# EasyEDA Pro project wukong01-Y003-HTOL.eprj, board PCB1 (continued)
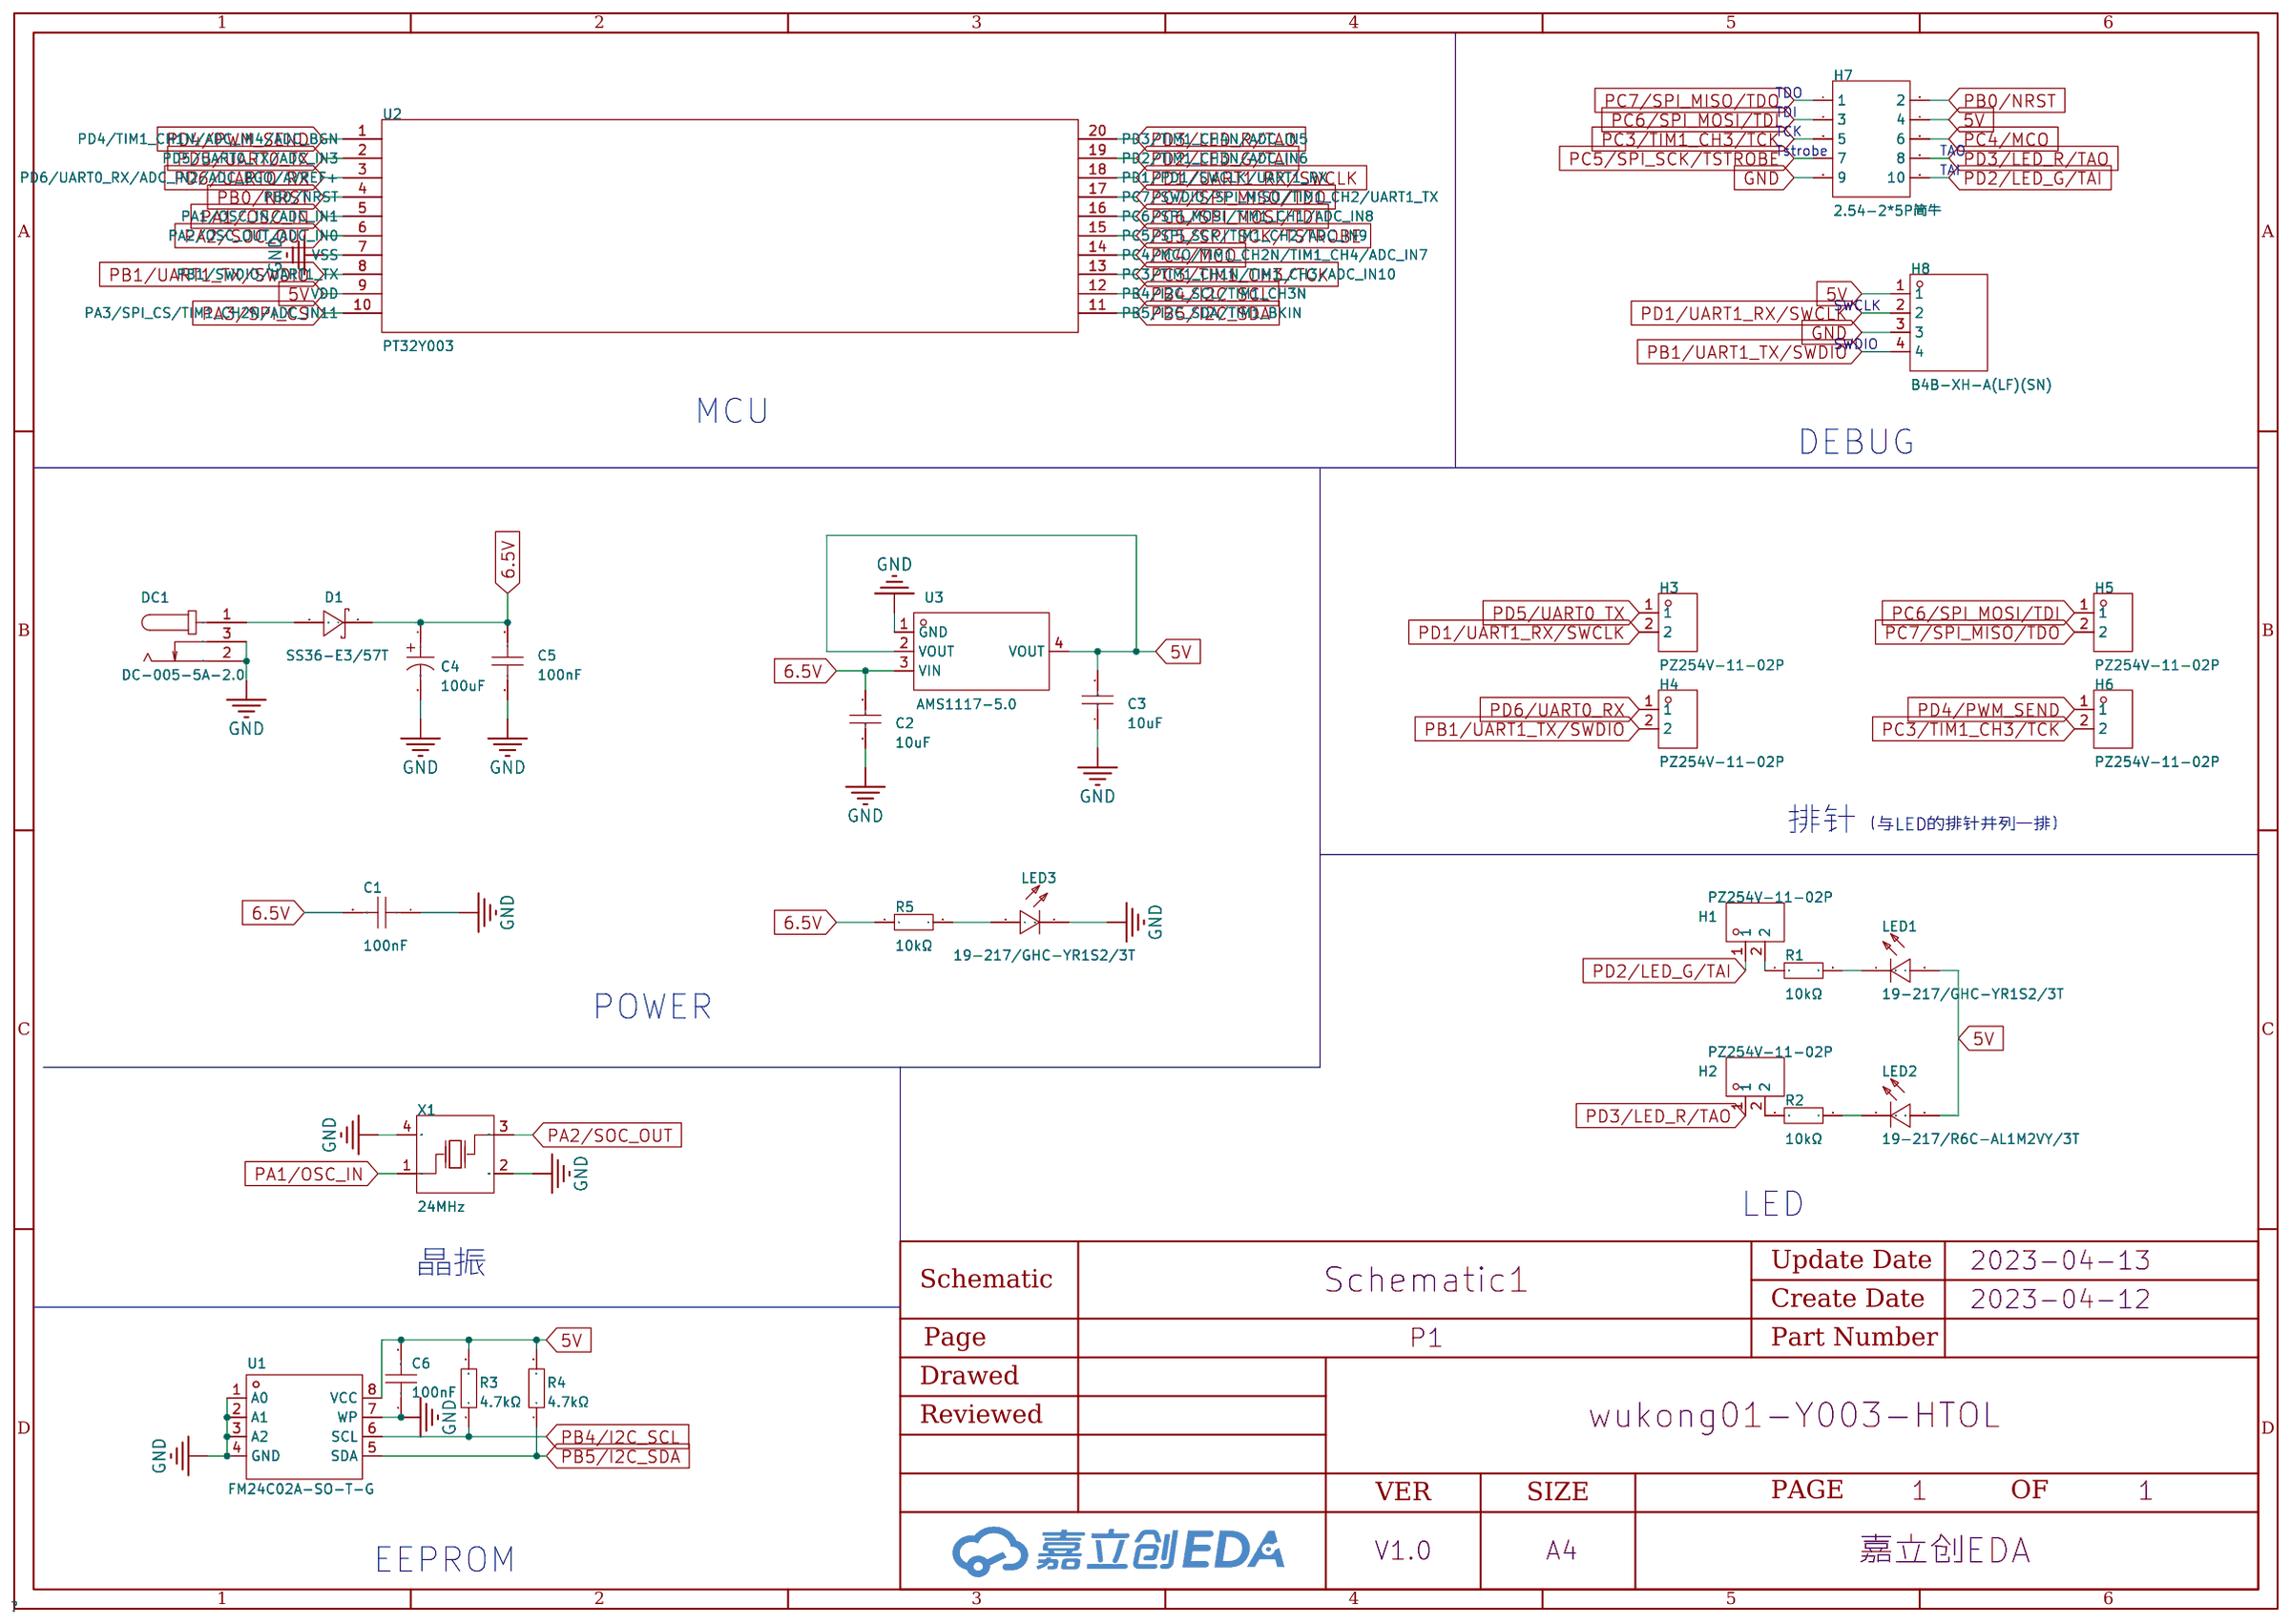
[diagram p0: schematic sheet]
## Routing (per net, layer and track width the routed paths; a pad name or vN(x,y) marks a point on that pad's centre or on a via; arc(x,y) is an arc through that point) (continued)
PA1/OSC_IN: length 642.8
  Top Layer w0.254: X1#7.1 63.82,283.43 72.34,274.9 U2#9.5 ; X1.1 210.88,111.72 219.41,103.2 U2#4.5 ; U2#37.5 268.43,146.12 259.9,154.65 X1#38.1 ; U2#32.5 219.41,189.05 210.88,197.57 X1#29.1 ; U2#11.5 121.36,274.9 112.84,283.43 X1#9.1 ; U2#22.5 23.32,17.34 14.79,25.87 X1#22.1 ; U2#29.5 23.32,231.97 14.79,240.5 X1#27.1 ; X1#3.1 112.84,111.72 121.36,103.2 U2#2.5 ; U2#19.5 219.41,60.27 210.88,68.8 X1#19.1 ; U2#25.5 268.43,231.97 259.9,240.5 X1#26.1 ; U2#18.5 121.36,17.34 112.84,25.87 X1#13.1 ; U2#23.5 72.34,17.34 63.82,25.87 X1#14.1 ; X1#39.1 14.79,154.65 23.32,146.12 U2.5 ; U2#3.5 268.43,103.2 259.9,111.72 X1#4.1 ; X1#17.1 14.79,68.8 23.32,60.27 U2#20.5 ; X1#40.1 161.86,154.65 170.39,146.12 U2#40.5 ; X1#33.1 14.79,197.57 23.32,189.05 U2#35.5 ; U2#27.5 72.34,231.97 63.82,240.5 X1#24.1 ; U2#8.5 23.32,103.2 14.79,111.72 X1#5.1 ; X1#8.1 161.86,283.43 170.39,274.9 U2#10.5 ; U2#33.5 72.34,189.05 63.82,197.57 X1#30.1 ; U2#21.5 219.41,17.34 210.88,25.87 X1#20.1 ; X1#36.1 63.82,154.65 72.34,146.12 U2#39.5 ; U2#13.5 268.43,274.9 259.9,283.43 X1#11.1 ; X1#37.1 112.84,154.65 121.36,146.12 U2#36.5 ; X1#21.1 161.86,25.87 170.39,17.34 U2#17.5 ; U2#15.5 121.36,60.27 112.84,68.8 X1#18.1 ; X1#10.1 63.82,68.8 72.34,60.27 U2#14.5 ; X1#34.1 161.86,197.57 170.39,189.05 U2#34.5 ; U2#7.5 170.39,60.27 161.86,68.8 X1#15.1 ; U2#26.5 219.41,231.97 210.88,240.5 X1#23.1 ; U2#30.5 121.36,189.05 112.84,197.57 X1#31.1 ; X1#32.1 259.9,197.57 268.43,189.05 U2#31.5 ; U2#28.5 170.39,231.97 161.86,240.5 X1#28.1 ; X1#6.1 161.86,111.72 170.39,103.2 U2#6.5 ; U2#38.5 219.41,146.12 210.88,154.65 X1#35.1 ; U2#24.5 121.36,231.97 112.84,240.5 X1#25.1 ; X1#16.1 259.9,68.8 268.43,60.27 U2#12.5 ; X1#12.1 210.88,283.43 219.41,274.9 U2#16.5 ; X1#2.1 63.82,111.72 72.34,103.2 U2#5.5
PA2/SOC_OUT: length 713.4
  Top Layer w0.254: U2#34.6 166.82,188.4 159.35,195.87 X1#34.3 ; X1#35.3 208.37,152.95 215.84,145.47 U2#38.6 ; X1#5.3 12.28,110.02 19.76,102.55 U2#8.6 ; X1#29.3 208.37,195.87 215.84,188.4 U2#32.6 ; 76,59.62 68.78,59.62 61.3,67.09 61.26,67.09 ; X1#4.3 257.39,110.02 264.87,102.55 U2#3.6 ; U2#37.6 264.87,145.47 257.39,152.95 X1#38.3 ; 125.02,59.62 117.8,59.62 110.32,67.09 110.28,67.09 ; X1#33.3 12.28,195.87 19.76,188.4 U2#35.6 ; U2#33.6 68.78,188.4 61.3,195.87 X1#30.3 ; X1#20.3 208.37,24.17 215.84,16.69 U2#21.6 ; U2#17.6 166.82,16.69 159.35,24.17 X1#21.3 ; U2#11.6 117.8,274.25 110.32,281.73 X1#9.3 ; X1#2.3 61.3,110.02 68.78,102.55 U2#5.6 ; X1.3 208.37,110.02 215.84,102.55 U2#4.6 ; X1#24.3 61.3,238.8 68.78,231.32 U2#27.6 ; X1#14.3 61.3,24.17 68.78,16.69 U2#23.6 ; 12.24,67.09 12.28,67.09 19.76,59.62 26.97,59.62 ; 223.06,59.62 215.84,59.62 208.37,67.09 208.32,67.09 ; X1#25.3 110.32,238.8 117.8,231.32 U2#24.6 ; U2#28.6 166.82,231.32 159.35,238.8 X1#28.3 ; U2#30.6 117.8,188.4 110.32,195.87 X1#31.3 ; X1#3.3 110.32,110.02 117.8,102.55 U2#2.6 ; X1#7.3 61.3,281.73 68.78,274.25 U2#9.6 ; X1#13.3 110.32,24.17 117.8,16.69 U2#18.6 ; X1#8.3 159.35,281.73 166.82,274.25 U2#10.6 ; X1#32.3 257.39,195.87 264.87,188.4 U2#31.6 ; U2#13.6 264.87,274.25 257.39,281.73 X1#11.3 ; X1#37.3 110.32,152.95 117.8,145.47 U2#36.6 ; U2#6.6 166.82,102.55 159.35,110.02 X1#6.3 ; U2#22.6 19.76,16.69 12.28,24.17 X1#22.3 ; 159.3,67.09 159.35,67.09 166.82,59.62 174.04,59.62 ; X1#36.3 61.3,152.95 68.78,145.47 U2#39.6 ; U2#26.6 215.84,231.32 208.37,238.8 X1#23.3 ; X1#12.3 208.37,281.73 215.84,274.25 U2#16.6 ; U2#40.6 166.82,145.47 159.35,152.95 X1#40.3 ; X1#27.3 12.28,238.8 19.76,231.32 U2#29.6 ; X1#26.3 257.39,238.8 264.87,231.32 U2#25.6 ; X1#39.3 12.28,152.95 19.76,145.47 U2.6 ; 257.35,67.09 257.39,67.09 264.87,59.62 272.08,59.62
PB0/NRST: length 724.6
  Top Layer w0.254: 171.7,202.06 169.93,202.06 169.16,201.3 169.16,191.77 171.24,189.7 174.04,189.7 ; U2#10.4 171.24,275.55 169.16,277.62 169.16,287.15 169.93,287.91 171.7,287.91 ; H7#24.2 71.88,244.98 71.12,244.22 71.12,234.7 73.19,232.62 U2#27.4 ; U2#9.4 73.19,275.55 71.12,277.62 71.12,287.15 71.88,287.91 H7#7.2 ; H7#10.2 267.97,287.91 267.21,287.15 267.21,277.62 269.28,275.55 U2#13.4 ; U2#12.4 269.28,60.92 267.21,62.99 267.21,72.52 267.97,73.28 H7#13.2 ; 76,189.7 73.19,189.7 71.12,191.77 71.12,201.3 71.88,202.06 H7#30.2 ; H7#5.2 218.95,116.21 218.19,115.44 218.19,105.92 220.26,103.84 U2#4.4 ; U2#7.4 171.24,60.92 169.16,62.99 169.16,72.52 169.93,73.28 171.7,73.28 ; H7#23.2 120.9,244.98 120.14,244.22 120.14,234.7 122.22,232.62 U2#24.4 ; H7#9.2 120.9,287.91 120.14,287.15 120.14,277.62 122.22,275.55 U2#11.4 ; U2#8.4 24.17,103.84 22.1,105.92 22.1,115.44 22.86,116.21 24.64,116.21 ; U2#19.4 220.26,60.92 218.19,62.99 218.19,72.52 218.95,73.28 H7#22.2 ; U2#5.4 73.19,103.84 71.12,105.92 71.12,115.44 71.88,116.21 H7#2.2 ; U2#14.4 73.19,60.92 71.12,62.99 71.12,72.52 71.88,73.28 H7#15.2 ; U2#2.4 122.22,103.84 120.14,105.92 120.14,115.44 120.9,116.21 H7.2 ; H7#36.2 71.88,159.13 71.12,158.37 71.12,148.84 73.19,146.77 U2#39.4 ; 76,17.99 73.19,17.99 71.12,20.07 71.12,29.59 71.88,30.35 H7#19.2 ; U2#25.4 269.28,232.62 267.21,234.7 267.21,244.22 267.97,244.98 H7#26.2 ; 171.7,116.21 169.93,116.21 169.16,115.44 169.16,105.92 171.24,103.84 U2#6.4 ; U2.4 24.17,146.77 22.1,148.84 22.1,158.37 22.86,159.13 24.64,159.13 ; H7#4.2 267.97,116.21 267.21,115.44 267.21,105.92 269.28,103.84 U2#3.4 ; 24.64,30.35 22.86,30.35 22.1,29.59 22.1,20.07 24.17,17.99 26.97,17.99 ; U2#29.4 24.17,232.62 22.1,234.7 22.1,244.22 22.86,244.98 24.64,244.98 ; 125.02,189.7 122.22,189.7 120.14,191.77 120.14,201.3 120.9,202.06 H7#29.2 ; H7#39.2 218.95,159.13 218.19,158.37 218.19,148.84 220.26,146.77 U2#38.4 ; H7#38.2 267.97,159.13 267.21,158.37 267.21,148.84 269.28,146.77 U2#37.4 ; 223.06,17.99 220.26,17.99 218.19,20.07 218.19,29.59 218.95,30.35 H7#18.2 ; 171.7,244.98 169.93,244.98 169.16,244.22 169.16,234.7 171.24,232.62 U2#28.4 ; H7#14.2 218.95,287.91 218.19,287.15 218.19,277.62 220.26,275.55 U2#16.4 ; H7#33.2 218.95,202.06 218.19,201.3 218.19,191.77 220.26,189.7 223.06,189.7 ; 272.08,189.7 269.28,189.7 267.21,191.77 267.21,201.3 267.97,202.06 H7#32.2 ; 26.97,189.7 24.17,189.7 22.1,191.77 22.1,201.3 22.86,202.06 24.64,202.06 ; 171.7,159.13 169.93,159.13 169.16,158.37 169.16,148.84 171.24,146.77 U2#40.4 ; U2#20.4 24.17,60.92 22.1,62.99 22.1,72.52 22.86,73.28 24.64,73.28 ; 125.02,17.99 122.22,17.99 120.14,20.07 120.14,29.59 120.9,30.35 H7#20.2 ; H7#35.2 120.9,159.13 120.14,158.37 120.14,148.84 122.22,146.77 U2#36.4 ; U2#26.4 220.26,232.62 218.19,234.7 218.19,244.22 218.95,244.98 H7#27.2 ; H7#17.2 120.9,73.28 120.14,72.52 120.14,62.99 122.22,60.92 U2#15.4 ; 171.7,30.35 169.93,30.35 169.16,29.59 169.16,20.07 171.24,17.99 174.04,17.99
PB1/UART1_TX/SWDIO: length 4713.6
  Top Layer w0.254: U2#9.8 62.64,272.95 v1(62.23,272.54) ; v1(209.3,229.62) 209.7,230.02 U2#26.8 ; v1(209.3,272.54) 209.7,272.95 U2#16.8 ; U2#28.8 160.68,230.02 v1(160.27,229.62) ; v1(111.25,14.99) 111.66,15.39 U2#18.8 ; v1(258.32,100.84) 258.73,101.25 U2#3.8 ; v1(258.32,272.54) 258.73,272.95 U2#13.8 ; U2#22.8 13.62,15.39 v1(13.21,14.99) ; U2#20.8 13.62,58.32 v1(13.21,57.91) ; v1(13.21,186.69) 13.62,187.1 U2#35.8 ; v1(13.21,100.84) 13.62,101.25 U2#8.8 ; U2#21.8 209.7,15.39 v1(209.3,14.99) ; U2#24.8 111.66,230.02 v1(111.25,229.62) ; U2#38.8 209.7,144.17 v1(209.3,143.76) ; U2#25.8 258.73,230.02 v1(258.32,229.62) ; U2#31.8 258.73,187.1 v1(258.32,186.69) ; v1(62.23,186.69) 62.64,187.1 U2#33.8 ; U2#15.8 111.66,58.32 v1(111.25,57.91) ; v1(160.27,57.91) 160.68,58.32 U2#7.8 ; v1(209.3,57.91) 209.7,58.32 U2#19.8 ; U2#2.8 111.66,101.25 v1(111.25,100.84) ; U2#23.8 62.64,15.39 v1(62.23,14.99) ; U2#32.8 209.7,187.1 v1(209.3,186.69) ; U2#10.8 160.68,272.95 v1(160.27,272.54) ; v1(111.25,186.69) 111.66,187.1 U2#30.8 ; U2#5.8 62.64,101.25 v1(62.23,100.84) ; v1(111.25,272.54) 111.66,272.95 U2#11.8 ; v1(258.32,57.91) 258.73,58.32 U2#12.8 ; v1(13.21,229.62) 13.62,230.02 U2#29.8 ; v1(13.21,143.76) 13.62,144.17 U2.8 ; U2#40.8 160.68,144.17 v1(160.27,143.76) ; U2#37.8 258.73,144.17 v1(258.32,143.76) ; v1(160.27,14.99) 160.68,15.39 U2#17.8 ; U2#34.8 160.68,187.1 v1(160.27,186.69) ; v1(62.23,57.91) 62.64,58.32 U2#14.8 ; U2#6.8 160.68,101.25 v1(160.27,100.84) ; U2#36.8 111.66,144.17 v1(111.25,143.76) ; U2#4.8 209.7,101.25 v1(209.3,100.84) ; U2#39.8 62.64,144.17 v1(62.23,143.76) ; U2#27.8 62.64,230.02 v1(62.23,229.62)
  Bottom Layer w0.254: H8#6.4 46.48,123.7 47.62,122.56 H4#5.2 54.61,109.47 55.24,108.84 55.24,92.84 53.47,91.06 14.61,91.06 13.21,92.46 v1(13.21,100.84) ; v1(160.27,272.54) 160.27,264.16 161.67,262.76 200.53,262.76 202.31,264.54 202.31,280.54 201.68,281.18 H4#8.2 194.69,294.26 193.55,295.4 H8#8.4 ; H8#34.4 46.48,209.55 47.62,208.41 H4#33.2 54.61,195.33 55.24,194.69 55.24,178.69 53.47,176.91 14.61,176.91 13.21,178.31 v1(13.21,186.69) ; H8#33.4 242.57,209.55 243.71,208.41 H4#32.2 250.7,195.33 251.33,194.69 251.33,178.69 249.56,176.91 210.69,176.91 209.3,178.31 v1(209.3,186.69) ; v1(62.23,272.54) 62.23,264.16 63.63,262.76 102.49,262.76 104.27,264.54 104.27,280.54 103.63,281.18 H4#7.2 96.65,294.26 95.5,295.4 H8#7.4 ; H8#4.4 291.59,123.7 292.74,122.56 H4#6.2 299.72,109.47 300.36,108.84 300.36,92.84 298.58,91.06 259.72,91.06 258.32,92.46 v1(258.32,100.84) ; H8#39.4 242.57,166.62 243.71,165.48 H4#38.2 250.7,152.4 251.33,151.77 251.33,135.76 249.56,133.99 210.69,133.99 209.3,135.38 v1(209.3,143.76) ; v1(209.3,272.54) 209.3,264.16 210.69,262.76 249.56,262.76 251.33,264.54 251.33,280.54 250.7,281.18 H4#11.2 243.71,294.26 242.57,295.4 H8#15.4 ; v1(209.3,14.99) 209.3,6.6 210.69,5.21 249.56,5.21 251.33,6.99 251.33,22.99 250.7,23.62 H4#21.2 243.71,36.7 242.57,37.85 H8#21.4 ; v1(160.27,14.99) 160.27,6.6 161.67,5.21 200.53,5.21 202.31,6.99 202.31,22.99 201.68,23.62 H4#17.2 194.69,36.7 193.55,37.85 H8#19.4 ; H8#9.4 144.53,295.4 145.67,294.26 H4#9.2 152.65,281.18 153.29,280.54 153.29,264.54 151.51,262.76 112.65,262.76 111.25,264.16 v1(111.25,272.54) ; v1(62.23,186.69) 62.23,178.31 63.63,176.91 102.49,176.91 104.27,178.69 104.27,194.69 103.63,195.33 H4#30.2 96.65,208.41 95.5,209.55 H8#29.4 ; v1(62.23,57.91) 62.23,49.53 63.63,48.13 102.49,48.13 104.27,49.91 104.27,65.91 103.63,66.55 H4#15.2 96.65,79.63 95.5,80.77 H8#12.4 ; H8#23.4 95.5,252.48 96.65,251.33 H4#24.2 103.63,238.25 104.27,237.62 104.27,221.62 102.49,219.84 63.63,219.84 62.23,221.23 v1(62.23,229.62) ; H8#14.4 291.59,80.77 292.74,79.63 H4#18.2 299.72,66.55 300.36,65.91 300.36,49.91 298.58,48.13 259.72,48.13 258.32,49.53 v1(258.32,57.91) ; H8#11.4 46.48,80.77 47.62,79.63 H4#13.2 54.61,66.55 55.24,65.91 55.24,49.91 53.47,48.13 14.61,48.13 13.21,49.53 v1(13.21,57.91) ; v1(62.23,100.84) 62.23,92.46 63.63,91.06 102.49,91.06 104.27,92.84 104.27,108.84 103.63,109.47 H4#2.2 96.65,122.56 95.5,123.7 H8.4 ; H8#13.4 193.55,80.77 194.69,79.63 H4#12.2 201.68,66.55 202.31,65.91 202.31,49.91 200.53,48.13 161.67,48.13 160.27,49.53 v1(160.27,57.91) ; v1(209.3,57.91) 209.3,49.53 210.69,48.13 249.56,48.13 251.33,49.91 251.33,65.91 250.7,66.55 H4#19.2 243.71,79.63 242.57,80.77 H8#22.4 ; H8#40.4 46.48,166.62 47.62,165.48 H4#39.2 54.61,152.4 55.24,151.77 55.24,135.76 53.47,133.99 14.61,133.99 13.21,135.38 v1(13.21,143.76) ; v1(111.25,100.84) 111.25,92.46 112.65,91.06 151.51,91.06 153.29,92.84 153.29,108.84 152.65,109.47 H4#3.2 145.67,122.56 144.53,123.7 H8#3.4 ; H8#31.4 144.53,209.55 145.67,208.41 H4#31.2 152.65,195.33 153.29,194.69 153.29,178.69 151.51,176.91 112.65,176.91 111.25,178.31 v1(111.25,186.69) ; v1(13.21,229.62) 13.21,221.23 14.61,219.84 53.47,219.84 55.24,221.62 55.24,237.62 54.61,238.25 H4#27.2 47.62,251.33 46.48,252.48 H8#28.4 ; H8#30.4 193.55,209.55 194.69,208.41 H4#29.2 201.68,195.33 202.31,194.69 202.31,178.69 200.53,176.91 161.67,176.91 160.27,178.31 v1(160.27,186.69) ; v1(111.25,57.91) 111.25,49.53 112.65,48.13 151.51,48.13 153.29,49.91 153.29,65.91 152.65,66.55 H4#16.2 145.67,79.63 144.53,80.77 H8#18.4 ; H8#20.4 144.53,37.85 145.67,36.7 H4#22.2 152.65,23.62 153.29,22.99 153.29,6.99 151.51,5.21 112.65,5.21 111.25,6.6 v1(111.25,14.99) ; v1(62.23,143.76) 62.23,135.38 63.63,133.99 102.49,133.99 104.27,135.76 104.27,151.77 103.63,152.4 H4#36.2 96.65,165.48 95.5,166.62 H8#35.4 ; H8#27.4 242.57,252.48 243.71,251.33 H4#26.2 250.7,238.25 251.33,237.62 251.33,221.62 249.56,219.84 210.69,219.84 209.3,221.23 v1(209.3,229.62) ; H8#26.4 291.59,252.48 292.74,251.33 H4#28.2 299.72,238.25 300.36,237.62 300.36,221.62 298.58,219.84 259.72,219.84 258.32,221.23 v1(258.32,229.62) ; H8#25.4 144.53,252.48 145.67,251.33 H4#25.2 152.65,238.25 153.29,237.62 153.29,221.62 151.51,219.84 112.65,219.84 111.25,221.23 v1(111.25,229.62) ; H8#10.4 291.59,295.4 292.74,294.26 H4#10.2 299.72,281.18 300.36,280.54 300.36,264.54 298.58,262.76 259.72,262.76 258.32,264.16 v1(258.32,272.54) ; H8#16.4 95.5,37.85 96.65,36.7 H4#20.2 103.63,23.62 104.27,22.99 104.27,6.99 102.49,5.21 63.63,5.21 62.23,6.6 v1(62.23,14.99) ; v1(111.25,143.76) 111.25,135.38 112.65,133.99 151.51,133.99 153.29,135.76 153.29,151.77 152.65,152.4 H4#37.2 145.67,165.48 144.53,166.62 H8#37.4 ; v1(160.27,143.76) 160.27,135.38 161.67,133.99 200.53,133.99 202.31,135.76 202.31,151.77 201.68,152.4 H4#35.2 194.69,165.48 193.55,166.62 H8#36.4 ; v1(160.27,100.84) 160.27,92.46 161.67,91.06 200.53,91.06 202.31,92.84 202.31,108.84 201.68,109.47 H4.2 194.69,122.56 193.55,123.7 H8#2.4 ; v1(160.27,229.62) 160.27,221.23 161.67,219.84 200.53,219.84 202.31,221.62 202.31,237.62 201.68,238.25 H4#23.2 194.69,251.33 193.55,252.48 H8#24.4 ; H8#5.4 242.57,123.7 243.71,122.56 H4#4.2 250.7,109.47 251.33,108.84 251.33,92.84 249.56,91.06 210.69,91.06 209.3,92.46 v1(209.3,100.84) ; v1(258.32,186.69) 258.32,178.31 259.72,176.91 298.58,176.91 300.36,178.69 300.36,194.69 299.72,195.33 H4#34.2 292.74,208.41 291.59,209.55 H8#32.4 ; v1(13.21,14.99) 13.21,6.6 14.61,5.21 53.47,5.21 55.24,6.99 55.24,22.99 54.61,23.62 H4#14.2 47.62,36.7 46.48,37.85 H8#17.4 ; H8#38.4 291.59,166.62 292.74,165.48 H4#40.2 299.72,152.4 300.36,151.77 300.36,135.76 298.58,133.99 259.72,133.99 258.32,135.38 v1(258.32,143.76)
PB4/I2C_SCL: length 1278.1
  Top Layer w0.254: v1(267.34,224.79) 267.34,223.53 R3#28.1 ; v1(83.31,12.19) v1(71.25,12.19) 65,12.19 ; U2#22.12 36.31,14.74 37.85,13.21 v1(37.85,12.19) ; v1(86.87,98.04) 86.87,99.06 85.33,100.59 U2#5.12 ; 130.76,57.67 134.36,57.67 135.89,56.13 v1(135.89,55.12) ; v1(279.4,269.75) v1(267.34,269.75) 261.09,269.75 ; v1(184.91,183.9) 184.91,184.91 183.38,186.45 U2#34.12 ; v1(135.89,12.19) 135.89,13.21 134.36,14.74 130.76,14.74 ; v1(181.36,183.9) v1(169.29,183.9) 163.05,183.9 ; 130.76,229.37 134.36,229.37 135.89,227.84 v1(135.89,226.82) ; R3#38.1 218.31,137.68 v1(218.31,138.94) ; v1(279.4,183.9) v1(267.34,183.9) 261.09,183.9 ; 65,269.75 v1(71.25,269.75) v1(83.31,269.75) ; R3#20.1 218.31,51.82 v1(218.31,53.09) ; v1(279.4,55.12) v1(267.34,55.12) 261.09,55.12 ; v1(120.27,53.09) 120.27,51.82 R3#15.1 ; 212.07,269.75 v1(218.31,269.75) v1(230.38,269.75) ; U2#17.12 183.38,14.74 184.91,13.21 v1(184.91,12.19) ; v1(86.87,140.97) 86.87,141.99 85.33,143.52 81.74,143.52 ; R3#34.1 267.34,180.6 v1(267.34,181.86) ; v1(233.93,140.97) 233.93,141.99 232.4,143.52 228.8,143.52 ; 212.07,226.82 v1(218.31,226.82) v1(230.38,226.82) ; v1(86.87,12.19) 86.87,13.21 85.33,14.74 U2#23.12 ; v1(233.93,55.12) 233.93,56.13 232.4,57.67 U2#19.12 ; U2#25.12 281.42,229.37 282.96,227.84 v1(282.96,226.82) ; U2#10.12 183.38,272.3 184.91,270.76 v1(184.91,269.75) ; v1(233.93,12.19) 233.93,13.21 232.4,14.74 U2#21.12 ; v1(181.36,140.97) v1(169.29,140.97) 163.05,140.97 ; U2#6.12 183.38,100.59 184.91,99.06 v1(184.91,98.04) ; R3#4.1 218.31,94.75 v1(218.31,96.01) ; v1(279.4,140.97) v1(267.34,140.97) 261.09,140.97 ; U2#3.12 281.42,100.59 282.96,99.06 v1(282.96,98.04) ; R3#2.1 169.29,137.68 v1(169.29,138.94) ; v1(218.31,267.72) 218.31,266.45 R3#13.1 ; v1(120.27,224.79) 120.27,223.53 R3#25.1 ; 212.07,12.19 v1(218.31,12.19) v1(230.38,12.19) ; R3#40.1 267.34,137.68 v1(267.34,138.94) ; v1(181.36,226.82) v1(169.29,226.82) 163.05,226.82 ; R3#30.1 169.29,223.53 v1(169.29,224.79) ; v1(71.25,224.79) 71.25,223.53 R3#27.1 ; 65,183.9 v1(71.25,183.9) v1(83.31,183.9) ; v1(184.91,55.12) 184.91,56.13 183.38,57.67 U2#7.12 ; U2#14.12 85.33,57.67 86.87,56.13 v1(86.87,55.12) ; v1(22.23,53.09) 22.23,51.82 R3#24.1 ; v1(267.34,53.09) 267.34,51.82 R3#17.1 ; R3#8.1 169.29,94.75 v1(169.29,96.01) ; v1(37.85,55.12) 37.85,56.13 36.31,57.67 U2#20.12 ; v1(135.89,183.9) 135.89,184.91 134.36,186.45 130.76,186.45 ; v1(83.31,226.82) v1(71.25,226.82) 65,226.82 ; U2#31.12 281.42,186.45 282.96,184.91 v1(282.96,183.9) ; v1(181.36,98.04) v1(169.29,98.04) 163.05,98.04 ; R3#32.1 218.31,180.6 v1(218.31,181.86) ; v1(169.29,181.86) 169.29,180.6 R3#36.1 ; 261.09,98.04 v1(267.34,98.04) v1(279.4,98.04) ; v1(34.29,140.97) v1(22.23,140.97) 15.98,140.97 ; v1(86.87,269.75) 86.87,270.76 85.33,272.3 U2#9.12 ; v1(22.23,138.94) 22.23,137.68 R3.1 ; R3#11.1 120.27,266.45 v1(120.27,267.72) ; v1(233.93,183.9) 233.93,184.91 232.4,186.45 U2#32.12 ; U2#16.12 232.4,272.3 233.93,270.76 v1(233.93,269.75) ; 32.72,143.52 36.31,143.52 37.85,141.99 v1(37.85,140.97) ; 114.03,55.12 v1(120.27,55.12) v1(132.33,55.12) ; R3#5.1 71.25,94.75 v1(71.25,96.01) ; v1(120.27,10.16) 120.27,8.9 R3#23.1 ; U2#29.12 36.31,229.37 37.85,227.84 v1(37.85,226.82) ; R3#16.1 169.29,8.9 v1(169.29,10.16) ; v1(181.36,55.12) v1(169.29,55.12) 163.05,55.12 ; v1(34.29,55.12) v1(22.23,55.12) 15.98,55.12 ; v1(132.33,269.75) v1(120.27,269.75) 114.03,269.75 ; v1(83.31,55.12) v1(71.25,55.12) 65,55.12 ; 212.07,55.12 v1(218.31,55.12) v1(230.38,55.12) ; 130.76,100.59 134.36,100.59 135.89,99.06 v1(135.89,98.04) ; v1(37.85,183.9) 37.85,184.91 36.31,186.45 U2#35.12 ; 15.98,12.19 v1(22.23,12.19) v1(34.29,12.19) ; v1(34.29,183.9) v1(22.23,183.9) 15.98,183.9 ; R3#18.1 169.29,51.82 v1(169.29,53.09) ; v1(230.38,140.97) v1(218.31,140.97) 212.07,140.97 ; R3#3.1 120.27,94.75 v1(120.27,96.01) ; U2#26.12 232.4,229.37 233.93,227.84 v1(233.93,226.82) ; 114.03,12.19 v1(120.27,12.19) v1(132.33,12.19) ; v1(230.38,183.9) v1(218.31,183.9) 212.07,183.9 ; v1(83.31,140.97) v1(71.25,140.97) 65,140.97 ; R3#31.1 120.27,180.6 v1(120.27,181.86) ; v1(37.85,98.04) 37.85,99.06 36.31,100.59 U2#8.12 ; U2#33.12 85.33,186.45 86.87,184.91 v1(86.87,183.9) ; U2#12.12 281.42,57.67 282.96,56.13 v1(282.96,55.12) ; R3#21.1 71.25,8.9 v1(71.25,10.16) ; R3#26.1 218.31,223.53 v1(218.31,224.79) ; R3#22.1 22.23,8.9 v1(22.23,10.16) ; v1(22.23,181.86) 22.23,180.6 R3#35.1 ; R3#39.1 71.25,137.68 v1(71.25,138.94) ; U2#13.12 281.42,272.3 282.96,270.76 v1(282.96,269.75) ; v1(184.91,226.82) 184.91,227.84 183.38,229.37 U2#28.12 ; v1(218.31,10.16) 218.31,8.9 R3#19.1 ; v1(34.29,98.04) v1(22.23,98.04) 15.98,98.04 ; v1(135.89,269.75) 135.89,270.76 134.36,272.3 130.76,272.3 ; v1(22.23,224.79) 22.23,223.53 R3#29.1 ; 114.03,226.82 v1(120.27,226.82) v1(132.33,226.82) ; v1(279.4,226.82) v1(267.34,226.82) 261.09,226.82 ; v1(233.93,98.04) 233.93,99.06 232.4,100.59 U2#4.12 ; 212.07,98.04 v1(218.31,98.04) v1(230.38,98.04) ; 277.83,143.52 281.42,143.52 282.96,141.99 v1(282.96,140.97) ; v1(132.33,98.04) v1(120.27,98.04) 114.03,98.04 ; R3#12.1 267.34,266.45 v1(267.34,267.72) ; 114.03,140.97 v1(120.27,140.97) v1(132.33,140.97) ; 163.05,12.19 v1(169.29,12.19) v1(181.36,12.19) ; 130.76,143.52 134.36,143.52 135.89,141.99 v1(135.89,140.97) ; v1(22.23,96.01) 22.23,94.75 R3#7.1 ; R3#33.1 71.25,180.6 v1(71.25,181.86) ; v1(132.33,183.9) v1(120.27,183.9) 114.03,183.9 ; v1(184.91,140.97) 184.91,141.99 183.38,143.52 179.78,143.52 ; v1(120.27,138.94) 120.27,137.68 R3#37.1 ; 65,98.04 v1(71.25,98.04) v1(83.31,98.04) ; v1(71.25,53.09) 71.25,51.82 R3#14.1 ; v1(169.29,267.72) 169.29,266.45 R3#10.1 ; v1(181.36,269.75) v1(169.29,269.75) 163.05,269.75 ; v1(86.87,226.82) 86.87,227.84 85.33,229.37 U2#27.12 ; v1(267.34,96.01) 267.34,94.75 R3#6.1 ; 15.98,226.82 v1(22.23,226.82) v1(34.29,226.82) ; R3#9.1 71.25,266.45 v1(71.25,267.72)
  Bottom Layer w0.254: v1(184.91,140.97) v1(181.36,140.97) ; v1(282.96,226.82) v1(279.4,226.82) ; v1(233.93,226.82) v1(230.38,226.82) ; v1(135.89,183.9) v1(132.33,183.9) ; v1(218.31,98.04) v1(218.31,96.01) ; v1(218.31,269.75) v1(218.31,267.72) ; v1(71.25,98.04) v1(71.25,96.01) ; v1(120.27,226.82) v1(120.27,224.79) ; v1(282.96,183.9) v1(279.4,183.9) ; v1(282.96,269.75) v1(279.4,269.75) ; v1(86.87,12.19) v1(83.31,12.19) ; v1(22.23,140.97) v1(22.23,138.94) ; v1(22.23,98.04) v1(22.23,96.01) ; v1(169.29,183.9) v1(169.29,181.86) ; v1(22.23,183.9) v1(22.23,181.86) ; v1(169.29,12.19) v1(169.29,10.16) ; v1(282.96,98.04) v1(279.4,98.04) ; v1(218.31,226.82) v1(218.31,224.79) ; v1(22.23,55.12) v1(22.23,53.09) ; v1(120.27,98.04) v1(120.27,96.01) ; v1(86.87,226.82) v1(83.31,226.82) ; v1(135.89,226.82) v1(132.33,226.82) ; v1(282.96,55.12) v1(279.4,55.12) ; v1(71.25,55.12) v1(71.25,53.09) ; v1(169.29,226.82) v1(169.29,224.79) ; v1(233.93,98.04) v1(230.38,98.04) ; v1(135.89,140.97) v1(132.33,140.97) ; v1(22.23,226.82) v1(22.23,224.79) ; v1(86.87,269.75) v1(83.31,269.75) ; v1(135.89,98.04) v1(132.33,98.04) ; v1(218.31,183.9) v1(218.31,181.86) ; v1(184.91,12.19) v1(181.36,12.19) ; v1(184.91,226.82) v1(181.36,226.82) ; v1(218.31,55.12) v1(218.31,53.09) ; v1(120.27,12.19) v1(120.27,10.16) ; v1(169.29,140.97) v1(169.29,138.94) ; v1(120.27,55.12) v1(120.27,53.09) ; v1(233.93,55.12) v1(230.38,55.12) ; v1(22.23,12.19) v1(22.23,10.16) ; v1(267.34,269.75) v1(267.34,267.72) ; v1(184.91,269.75) v1(181.36,269.75) ; v1(37.85,183.9) v1(34.29,183.9) ; v1(233.93,269.75) v1(230.38,269.75) ; v1(37.85,12.19) v1(34.29,12.19) ; v1(267.34,98.04) v1(267.34,96.01) ; v1(267.34,183.9) v1(267.34,181.86) ; v1(267.34,55.12) v1(267.34,53.09) ; v1(37.85,98.04) v1(34.29,98.04) ; v1(135.89,55.12) v1(132.33,55.12) ; v1(120.27,183.9) v1(120.27,181.86) ; v1(135.89,269.75) v1(132.33,269.75) ; v1(218.31,12.19) v1(218.31,10.16) ; v1(267.34,140.97) v1(267.34,138.94) ; v1(120.27,140.97) v1(120.27,138.94) ; v1(86.87,98.04) v1(83.31,98.04) ; v1(233.93,183.9) v1(230.38,183.9) ; v1(233.93,140.97) v1(230.38,140.97) ; v1(267.34,226.82) v1(267.34,224.79) ; v1(37.85,226.82) v1(34.29,226.82) ; v1(184.91,55.12) v1(181.36,55.12) ; v1(71.25,226.82) v1(71.25,224.79) ; v1(169.29,269.75) v1(169.29,267.72) ; v1(71.25,269.75) v1(71.25,267.72) ; v1(71.25,140.97) v1(71.25,138.94) ; v1(71.25,12.19) v1(71.25,10.16) ; v1(37.85,55.12) v1(34.29,55.12) ; v1(37.85,140.97) v1(34.29,140.97) ; v1(184.91,183.9) v1(181.36,183.9) ; v1(86.87,140.97) v1(83.31,140.97) ; v1(282.96,140.97) v1(279.4,140.97) ; v1(169.29,98.04) v1(169.29,96.01) ; v1(71.25,183.9) v1(71.25,181.86) ; v1(135.89,12.19) v1(132.33,12.19) ; v1(86.87,55.12) v1(83.31,55.12) ; v1(218.31,140.97) v1(218.31,138.94) ; v1(169.29,55.12) v1(169.29,53.09) ; v1(86.87,183.9) v1(83.31,183.9) ; v1(184.91,98.04) v1(181.36,98.04) ; v1(120.27,269.75) v1(120.27,267.72) ; v1(233.93,12.19) v1(230.38,12.19)
PB5/I2C_SDA: length 1187.9
  Top Layer w0.254: 163.05,182.63 167.51,182.63 167.63,182.5 ; 20.57,10.8 20.57,10.92 35.05,10.92 35.43,11.3 35.43,13.33 34.67,14.09 32.72,14.09 ; 20.57,10.8 20.44,10.92 15.98,10.92 ; 20.57,10.8 20.57,9.27 20.57,9.26 20.57,7.87 21.21,7.24 R4#22.1 ; 20.57,139.57 20.57,139.7 35.05,139.7 35.43,140.08 35.43,142.11 34.67,142.87 U2.11 ; 20.57,139.57 20.44,139.7 15.98,139.7 ; 20.57,139.57 20.57,138.05 20.57,138.04 20.57,136.65 21.21,136.02 R4.1 ; R4#9.1 168.28,264.8 167.64,265.43 167.64,266.82 167.63,266.83 167.63,268.35 ; R4#13.1 119.25,50.17 118.62,50.8 118.62,52.19 118.61,52.2 118.61,53.72 ; 118.61,53.72 118.48,53.85 114.03,53.85 ; 118.61,53.72 118.61,53.85 133.1,53.85 133.48,54.23 133.48,56.26 132.72,57.02 130.76,57.02 ; R4#33.1 70.23,178.94 69.6,179.58 69.6,180.97 69.59,180.98 69.59,182.5 ; R4#2.1 119.25,93.09 118.62,93.73 118.62,95.12 118.61,95.12 118.61,96.65 ; 265.68,139.57 265.68,138.05 265.68,138.04 265.68,136.65 266.32,136.02 R4#37.1 ; 265.68,139.57 265.68,139.7 280.16,139.7 280.54,140.08 280.54,142.11 279.78,142.87 U2#37.11 ; 265.68,139.57 265.55,139.7 261.09,139.7 ; R4#12.1 168.28,50.17 167.64,50.8 167.64,52.19 167.63,52.2 167.63,53.72 ; R4#3.1 266.32,93.09 265.68,93.73 265.68,95.12 265.68,95.12 265.68,96.65 ; 216.66,96.65 216.66,96.77 231.14,96.77 231.52,97.16 231.52,99.18 230.76,99.95 228.8,99.95 ; 216.66,96.65 216.66,95.12 216.66,95.12 216.66,93.73 217.3,93.09 R4#4.1 ; 216.66,96.65 216.53,96.77 212.07,96.77 ; R4#35.1 21.21,178.94 20.57,179.58 20.57,180.97 20.57,180.98 20.57,182.5 ; U2#9.11 83.69,271.65 84.45,270.89 84.45,268.86 84.07,268.48 69.59,268.48 69.59,268.35 ; 167.63,225.43 167.51,225.55 163.05,225.55 ; 167.63,225.43 167.63,225.55 182.12,225.55 182.5,225.93 182.5,227.96 181.74,228.72 U2#28.11 ; 167.63,225.43 167.63,223.9 167.64,223.89 167.64,222.5 168.28,221.87 R4#28.1 ; 114.03,182.63 118.48,182.63 118.61,182.5 ; 163.05,53.85 167.51,53.85 167.63,53.72 ; 265.68,182.5 265.55,182.63 261.09,182.63 ; 265.68,182.5 265.68,180.98 265.68,180.97 265.68,179.58 266.32,178.94 R4#31.1 ; 265.68,182.5 265.68,182.63 280.16,182.63 280.54,183.01 280.54,185.04 279.78,185.8 U2#31.11 ; 216.66,182.5 216.53,182.63 212.07,182.63 ; 216.66,182.5 216.66,180.98 216.66,180.97 216.66,179.58 217.3,178.94 R4#32.1 ; 216.66,182.5 216.66,182.63 231.14,182.63 231.52,183.01 231.52,185.04 230.76,185.8 U2#32.11 ; 167.63,96.65 167.63,96.77 182.12,96.77 182.5,97.16 182.5,99.18 181.74,99.95 179.78,99.95 ; 167.63,96.65 167.63,95.12 167.64,95.12 167.64,93.73 168.28,93.09 R4#6.1 ; 167.63,96.65 167.51,96.77 163.05,96.77 ; 265.68,268.35 265.55,268.48 261.09,268.48 ; 265.68,268.35 265.68,268.48 280.16,268.48 280.54,268.86 280.54,270.89 279.78,271.65 U2#13.11 ; 265.68,268.35 265.68,266.83 265.68,266.82 265.68,265.43 266.32,264.8 R4#11.1 ; 265.68,53.72 265.68,52.2 265.68,52.19 265.68,50.8 266.32,50.17 R4#14.1 ; 265.68,53.72 265.68,53.85 280.16,53.85 280.54,54.23 280.54,56.26 279.78,57.02 U2#12.11 ; 265.68,53.72 265.55,53.85 261.09,53.85 ; U2#38.11 230.76,142.87 231.52,142.11 231.52,140.08 231.14,139.7 216.66,139.7 216.66,139.57 ; 163.05,10.92 167.51,10.92 167.63,10.8 ; 69.59,268.35 69.59,266.83 69.6,266.82 69.6,265.43 70.23,264.8 R4#8.1 ; 69.59,268.35 69.46,268.48 65,268.48 ; 118.61,225.43 118.61,225.55 133.1,225.55 133.48,225.93 133.48,227.96 132.72,228.72 130.76,228.72 ; 118.61,225.43 118.48,225.55 114.03,225.55 ; 118.61,225.43 118.61,223.9 118.62,223.89 118.62,222.5 119.25,221.87 R4#24.1 ; U2#26.11 230.76,228.72 231.52,227.96 231.52,225.93 231.14,225.55 216.66,225.55 216.66,225.43 ; 69.59,182.5 69.46,182.63 65,182.63 ; 69.59,182.5 69.59,182.63 84.07,182.63 84.45,183.01 84.45,185.04 83.69,185.8 U2#33.11 ; 216.66,225.43 216.53,225.55 212.07,225.55 ; 216.66,225.43 216.66,223.9 216.66,223.89 216.66,222.5 217.3,221.87 R4#26.1 ; 216.66,10.8 216.66,10.92 231.14,10.92 231.52,11.3 231.52,13.33 230.76,14.09 228.8,14.09 ; 216.66,10.8 216.66,9.27 216.66,9.26 216.66,7.87 217.3,7.24 R4#18.1 ; 216.66,10.8 216.53,10.92 212.07,10.92 ; 167.63,139.57 167.63,139.7 182.12,139.7 182.5,140.08 182.5,142.11 181.74,142.87 U2#40.11 ; 167.63,139.57 167.63,138.05 167.64,138.04 167.64,136.65 168.28,136.02 R4#40.1 ; 167.63,139.57 167.51,139.7 163.05,139.7 ; R4#10.1 119.25,264.8 118.62,265.43 118.62,266.82 118.61,266.83 118.61,268.35 ; U2#29.11 34.67,228.72 35.43,227.96 35.43,225.93 35.05,225.55 20.57,225.55 20.57,225.43 ; 118.61,96.65 118.48,96.77 114.03,96.77 ; 118.61,96.65 118.61,96.77 133.1,96.77 133.48,97.16 133.48,99.18 132.72,99.95 130.76,99.95 ; 167.63,10.8 167.63,9.27 167.64,9.26 167.64,7.87 168.28,7.24 R4#20.1 ; 167.63,10.8 167.63,10.92 182.12,10.92 182.5,11.3 182.5,13.33 181.74,14.09 179.78,14.09 ; R4#30.1 119.25,178.94 118.62,179.58 118.62,180.97 118.61,180.98 118.61,182.5 ; 118.61,139.57 118.61,139.7 133.1,139.7 133.48,140.08 133.48,142.11 132.72,142.87 130.76,142.87 ; 118.61,139.57 118.61,138.05 118.62,138.04 118.62,136.65 119.25,136.02 R4#36.1 ; 118.61,139.57 118.48,139.7 114.03,139.7 ; 20.57,225.43 20.44,225.55 15.98,225.55 ; 20.57,225.43 20.57,223.9 20.57,223.89 20.57,222.5 21.21,221.87 R4#29.1 ; R4#19.1 119.25,7.24 118.62,7.87 118.62,9.26 118.61,9.27 118.61,10.8 ; 118.61,268.35 118.61,268.48 133.1,268.48 133.48,268.86 133.48,270.89 132.72,271.65 130.76,271.65 ; 118.61,268.35 118.48,268.48 114.03,268.48 ; 65,139.7 69.46,139.7 69.59,139.57 ; 216.66,139.57 216.66,138.05 216.66,138.04 216.66,136.65 217.3,136.02 R4#38.1 ; 216.66,139.57 216.53,139.7 212.07,139.7 ; U2#35.11 34.67,185.8 35.43,185.04 35.43,183.01 35.05,182.63 20.57,182.63 20.57,182.5 ; 261.09,225.55 265.55,225.55 265.68,225.43 ; 15.98,53.85 20.44,53.85 20.57,53.72 ; 69.59,10.8 69.59,10.92 84.07,10.92 84.45,11.3 84.45,13.33 83.69,14.09 81.74,14.09 ; 69.59,10.8 69.46,10.92 65,10.92 ; 69.59,10.8 69.59,9.27 69.6,9.26 69.6,7.87 70.23,7.24 R4#23.1 ; 167.63,182.5 167.63,182.63 182.12,182.63 182.5,183.01 182.5,185.04 181.74,185.8 U2#34.11 ; 167.63,182.5 167.63,180.98 167.64,180.97 167.64,179.58 168.28,178.94 R4#34.1 ; 20.57,182.5 20.44,182.63 15.98,182.63 ; 167.63,268.35 167.63,268.48 182.12,268.48 182.5,268.86 182.5,270.89 181.74,271.65 U2#10.11 ; 167.63,268.35 167.51,268.48 163.05,268.48 ; R4#25.1 266.32,221.87 265.68,222.5 265.68,223.89 265.68,223.9 265.68,225.43 ; 167.63,53.72 167.63,53.85 182.12,53.85 182.5,54.23 182.5,56.26 181.74,57.02 U2#7.11 ; 130.76,185.8 132.72,185.8 133.48,185.04 133.48,183.01 133.1,182.63 118.61,182.63 118.61,182.5 ; U2#39.11 83.69,142.87 84.45,142.11 84.45,140.08 84.07,139.7 69.59,139.7 69.59,139.57 ; 69.59,139.57 69.59,138.05 69.6,138.04 69.6,136.65 70.23,136.02 R4#39.1 ; 65,225.55 69.46,225.55 69.59,225.43 ; 216.66,268.35 216.66,266.83 216.66,266.82 216.66,265.43 217.3,264.8 R4#15.1 ; 216.66,268.35 216.53,268.48 212.07,268.48 ; 216.66,268.35 216.66,268.48 231.14,268.48 231.52,268.86 231.52,270.89 230.76,271.65 U2#16.11 ; 69.59,96.65 69.59,95.12 69.6,95.12 69.6,93.73 70.23,93.09 R4#5.1 ; 69.59,96.65 69.59,96.77 84.07,96.77 84.45,97.16 84.45,99.18 83.69,99.95 81.74,99.95 ; 69.59,96.65 69.46,96.77 65,96.77 ; 114.03,10.92 118.48,10.92 118.61,10.8 ; 130.76,14.09 132.72,14.09 133.48,13.33 133.48,11.3 133.1,10.92 118.61,10.92 118.61,10.8 ; 265.68,225.43 265.68,225.55 280.16,225.55 280.54,225.93 280.54,227.96 279.78,228.72 U2#25.11 ; 69.59,225.43 69.59,223.9 69.6,223.89 69.6,222.5 70.23,221.87 R4#27.1 ; 69.59,225.43 69.59,225.55 84.07,225.55 84.45,225.93 84.45,227.96 83.69,228.72 U2#27.11 ; R4#21.1 217.3,50.17 216.66,50.8 216.66,52.19 216.66,52.2 216.66,53.72 ; 216.66,53.72 216.66,53.85 231.14,53.85 231.52,54.23 231.52,56.26 230.76,57.02 U2#19.11 ; 216.66,53.72 216.53,53.85 212.07,53.85 ; 69.59,53.72 69.59,52.2 69.6,52.19 69.6,50.8 70.23,50.17 R4#17.1 ; 69.59,53.72 69.46,53.85 65,53.85 ; 69.59,53.72 69.59,53.85 84.07,53.85 84.45,54.23 84.45,56.26 83.69,57.02 U2#14.11 ; 265.68,96.65 265.55,96.77 261.09,96.77 ; 265.68,96.65 265.68,96.77 280.16,96.77 280.54,97.16 280.54,99.18 279.78,99.95 277.83,99.95 ; 15.98,96.77 20.44,96.77 20.57,96.65 ; R4#7.1 21.21,93.09 20.57,93.73 20.57,95.12 20.57,95.12 20.57,96.65 ; 20.57,96.65 20.57,96.77 35.05,96.77 35.43,97.16 35.43,99.18 34.67,99.95 32.72,99.95 ; U2#20.11 34.67,57.02 35.43,56.26 35.43,54.23 35.05,53.85 20.57,53.85 20.57,53.72 ; 20.57,53.72 20.57,52.2 20.57,52.19 20.57,50.8 21.21,50.17 R4#16.1